# EasyEDA Pro project Foc驱动板.eprj, board PCB6
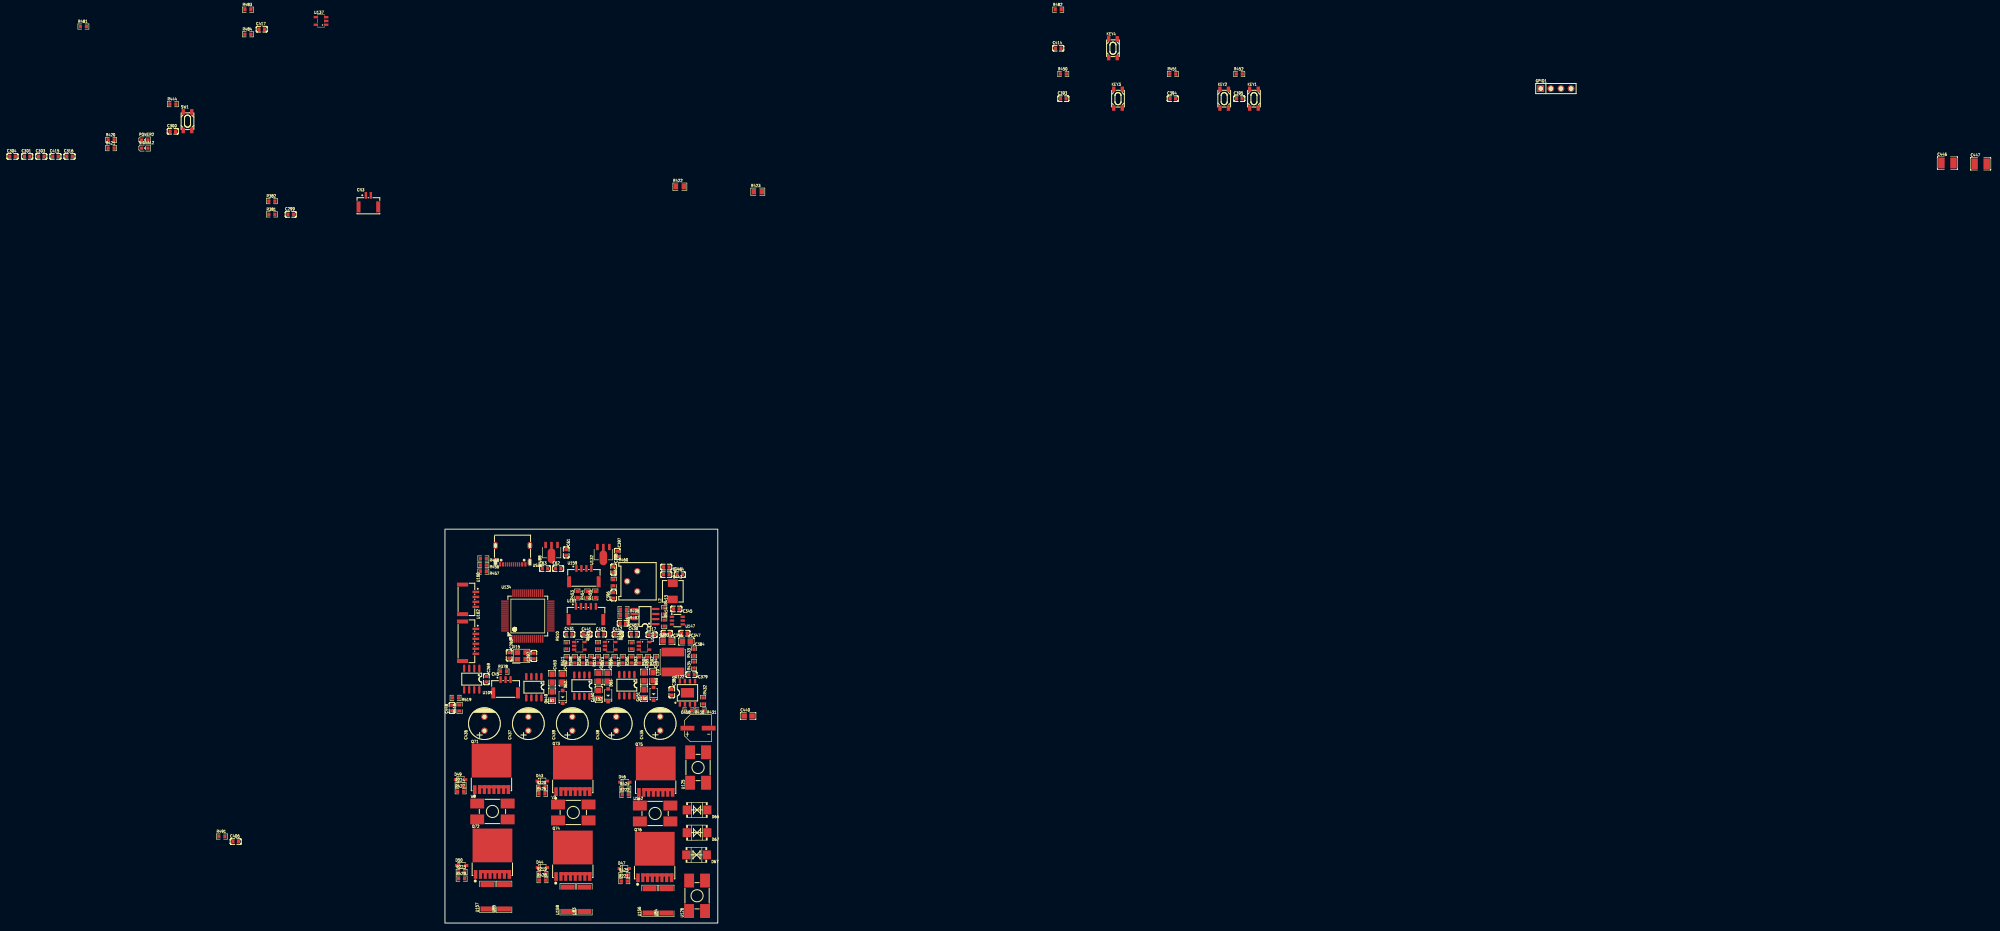
[diagram p14: board, top side]
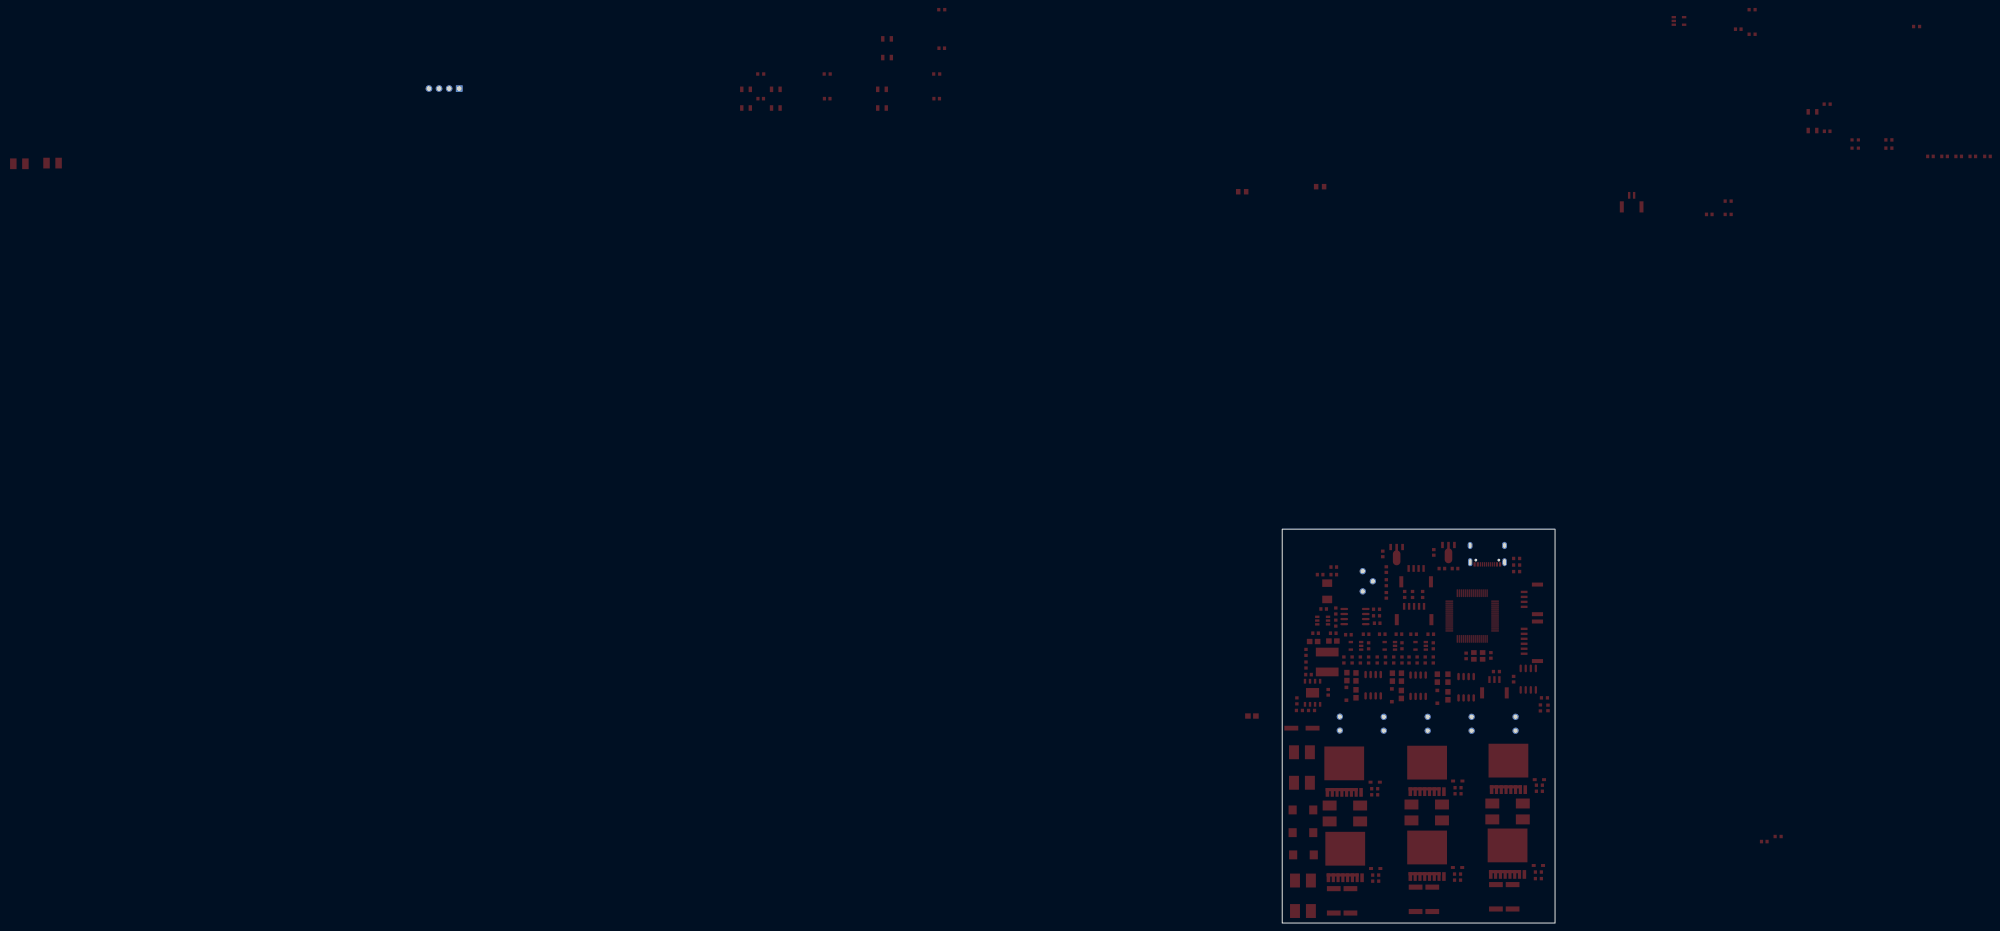
[diagram p15: board, bottom side, seen from below]

Outline 68.58 x 99.06 mm; copper layers: Top Layer, Bottom Layer. Coordinates in mm from the lower left corner of the outline.
Outline path: rectangle 0,99.06 68.58,0
Stack: Top Layer 0.035mm / Dielectric1 1.51mm FR4 er 4.5 / Bottom Layer 0.035mm

## Design rules (mm)
template: JLCPCB Capability(Two Layers Board)
spacing copperThickness1oz (default): track to track 0.102, other pairs 0.152 to 0.3
spacing copperThickness2oz: track to track 0.203, other pairs 0.152 to 0.3
track width copperThickness1oz (default): min 0.127, default 0.254, max 2.54
track width copperThickness2oz: min 0.203, default 0.254, max 2.54
differential pair differentialPair (default): width min 0.127, default 0.254, max 2.54; gap min 0.152, default 0.152
via viaSize (default): diameter min 0.5, default 0.61, max 10; hole min 0.3, default 0.305, max 6.3

## Placement (name value [footprint] x y rotation side)
C61  100nF  [C0603]  30.48 93.22 270 top
C62  10uF  [C0603]  28.45 89.15 0 top
C63  100nF  [C0603]  25.15 89.15 0 top
C269  100nF  [C0603]  10.41 61.34 270 top
C296  22pf  [C0603]  16.13 67.31 270 top
C297  22pf  [C0603]  22.35 67.18 90 top
C299  100nF  [C0603]  -38.77 178.23 0 top
C300  100nF  [C0603]  -68.41 199.13 0 top
C301  100nF  [C0603]  -105.02 192.82 0 top
C303  100nF  [C0603]  -101.47 192.82 0 top
C304  100nF  [C0603]  -108.7 192.82 0 top
C316  100nF  [C0603]  -94.37 192.82 0 top
C317  100nF  [C0603]  51.94 72.52 180 top
C345  100nF  [C0603]  58.17 78.99 180 top
C346  100nF  [C0603]  55.75 72.9 180 top
C347  22uF  [C0603]  60.2 72.9 180 top
C379  1uF  [C0603]  61.98 62.48 180 top
C380  100nF  [C0603]  57.02 58.04 270 top
C383  22uF  [C0805]  55.85 70.93 0 top
C384  22uF  [C0805]  60.69 70.81 180 top
C393  100nF  [C0603]  155.44 207.34 0 top
C394  100nF  [C0603]  182.97 207.34 0 top
C395  100nF  [C0603]  199.68 207.34 0 top
C396  1nF  [C0603]  42.42 82.42 90 top
C397  100nF  [C0603]  43.31 92.84 270 top
C398  10uF  [C0603]  42.42 88.9 270 top
C406  100nF  [C0603]  -52.6 20.49 0 top
C407  100nF  [C0603]  44.72 75.41 180 top
C414  100nF  [C0603]  154.17 220.03 0 top
C415  100nF  [C0603]  -97.92 192.82 0 top
C417  10nF  [C0603]  -46.06 224.81 0 top
C430  1nF  [C0603]  47.5 72.64 180 top
C431  1nF  [C0603]  31.24 72.64 180 top
C432  1nF  [C0603]  39.24 72.66 180 top
C435  100uF  [CAP-TH_BD8.0-P3.50-D0.5-FD]  54.1 50.16 90 top
C436  100uF  [CAP-TH_BD8.0-P3.50-D0.5-FD]  9.92 50.12 90 top
C437  100uF  [CAP-TH_BD8.0-P3.50-D0.5-FD]  20.97 50.12 90 top
C438  100uF  [CAP-TH_BD8.0-P3.50-D0.5-FD]  43.06 50.12 90 top
C439  100uF  [CAP-TH_BD8.0-P3.50-D0.5-FD]  32.01 50.12 90 top
C440  4.7uF  [C0805]  76.2 52.07 0 top
C441  100nF  [C0603]  35.56 72.64 180 top
C442  100nF  [C0603]  43.43 72.66 180 top
C443  22uF  [C0603]  55.63 87.63 180 top
C444  22uF  [C0603]  59.05 87.63 0 top
C445  100nF  [C0603]  55.63 89.53 180 top
C446  100uF  [C1210]  377.7 191.13 0 top
C447  100uF  [C1210]  386.04 190.96 0 top
C448  100nF  [C0603]  1.78 54.1 90 top
C449  4.7uF  [C0805]  26.92 57.15 90 top
C450  4.7uF  [C0805]  38.63 57.49 90 top
C451  4.7uF  [C0805]  50.04 57.66 90 top
C452  1uF  [C0805]  29.59 61.59 270 top
C453  100nF  [C0805]  26.92 61.59 270 top
C454  1uF  [C0805]  52.32 61.98 270 top
C455  100nF  [C0805]  50.05 61.91 270 top
C456  1uF  [C0805]  40.89 61.84 270 top
C457  100nF  [C0805]  38.61 61.85 270 top
C458  22uF  [CAP-SMD_BD6.3-L6.6-W6.6-LS7.4-FD]  63.63 49.02 0 top
CN3  -  [CONN-TH_2P-P1.25_XUNPU_WAFER-GH1.25-2PWB]  -19.26 181.57 0 top
CN5  WAFER-GH1.25-3PLB  [CONN-SMD_3P-P1.25_XUNPU_WAFER-GH1.25-3PLB]  15.24 59.56 0 top
D43  BAT43WS-7-F  [SOD-323_L1.8-W1.3-LS2.5-RD]  24.46 35.72 0 top
D44  BAT43WS-7-F  [SOD-323_L1.8-W1.3-LS2.5-RD]  24.51 13.97 0 top
D46  BAT43WS-7-F  [SOD-323_L1.8-W1.3-LS2.5-RD]  45.21 35.43 0 top
D47  BAT43WS-7-F  [SOD-323_L1.8-W1.3-LS2.5-RD]  45.08 13.72 0 top
D49  BAT43WS-7-F  [SOD-323_L1.8-W1.3-LS2.5-RD]  3.94 36.07 0 top
D50  BAT43WS-7-F  [SOD-323_L1.8-W1.3-LS2.5-RD]  4.19 14.48 0 top
D51  1N4148W  [SOD-123_L2.7-W1.6-LS3.7-FD]  41.02 57.28 270 top
D52  1N4148W  [SOD-123_L2.7-W1.6-LS3.7-FD]  29.59 56.9 270 top
D53  1N4148W  [SOD-123_L2.7-W1.6-LS3.7-FD]  52.45 57.66 270 top
D66  SMBJ48CA  [SMB_L4.6-W3.6-LS5.4-BI]  63.37 28.45 180 top
D67  SMBJ48CA  [SMB_L4.6-W3.6-LS5.4-BI]  63.25 17.15 180 top
D67#2  -  [SMB_L4.6-W3.6-LS5.4-BI]  63.37 22.73 180 top
GPIO1  PZ254V-11-04P  [HDR-TH_4P-P2.54-V-M]  279.27 209.88 0 top
KEY1  TS-1145A-B-A  [SW-SMD_4P-L4.2-W3.2-P2.15-LS5.2]  203.37 207.34 0 top
KEY2  TS-1145A-B-A  [SW-SMD_4P-L4.2-W3.2-P2.15-LS5.2]  195.89 207.34 0 top
KEY3  TS-1145A-B-A  [SW-SMD_4P-L4.2-W3.2-P2.15-LS5.2]  169.19 207.34 0 top
KEY4  TS-1145A-B-A  [SW-SMD_4P-L4.2-W3.2-P2.15-LS5.2]  167.92 220.03 0 top
L2  10uH  [IND-SMD_L5.4-W5.2_FXL0530]  57.28 83.44 90 top
L10  18uH  [IND-SMD_L6.0-W6.0]  57.28 65.66 90 top
POWER2  LTST-C190KSKT  [LED0603-RD]  -75.45 196.96 0 top
Q71  AGM4005LL  [TOLL-8_L10.4-W9.9-P1.20-LS11.7-BL]  11.72 37.2 0 top
Q72  AGM4005LL  [TOLL-8_L10.4-W9.9-P1.20-LS11.7-BL]  11.94 15.88 0 top
Q73  AGM4005LL  [TOLL-8_L10.4-W9.9-P1.20-LS11.7-BL]  32.16 36.69 0 top
Q74  AGM4005LL  [TOLL-8_L10.4-W9.9-P1.20-LS11.7-BL]  32.16 15.35 0 top
Q75  AGM4005LL  [TOLL-8_L10.4-W9.9-P1.20-LS11.7-BL]  52.99 36.51 0 top
Q76  AGM4005LL  [TOLL-8_L10.4-W9.9-P1.20-LS11.7-BL]  52.74 15.04 0 top
R219  10Ω  [R0603]  24.51 12.32 0 top
R220  10Ω  [R0603]  24.38 34.04 0 top
R221  10Ω  [R0603]  45.08 10.54 0 top
R222  10Ω  [R0603]  45.34 32.26 0 top
R223  10Ω  [R0603]  4.19 12.83 0 top
R224  10Ω  [R0603]  3.94 34.67 0 top
R378  120Ω  [R0603]  14.73 63.25 0 top
R381  KNTC0603/10KF3950  [R0603]  -43.52 178.23 0 top
R382  10kΩ  [R0603]  -43.52 181.57 0 top
R413  56KΩ  [R0603]  55.12 78.49 270 top
R414  7.5KΩ  [R0603]  55.12 75.44 270 top
R420  1kΩ  [R0603]  -83.92 196.96 0 top
R421  1kΩ  [R0603]  -83.92 194.9 0 top
R422  0Ω  [R0805]  59.06 185.2 0 top
R423  0Ω  [R0805]  78.64 183.94 0 top
R424  10kΩ  [R0603]  45.34 33.78 0 top
R425  10kΩ  [R0603]  45.08 12.06 0 top
R426  10kΩ  [R0603]  24.38 32.51 0 top
R427  10kΩ  [R0603]  3.94 33.15 0 top
R428  10kΩ  [R0603]  24.51 10.79 0 top
R429  10kΩ  [R0603]  4.19 11.18 0 top
R430  10KΩ  [R0603]  61.21 53.47 180 top
R431  1kΩ  [R0603]  64.26 53.47 180 top
R432  64.9KΩ  [R0603]  64.9 55.88 270 top
R433  100kΩ  [R0603]  62.61 68.07 90 top
R434  9.09kΩ  [R0603]  62.61 64.9 90 top
R444  10KΩ  [R0603]  -68.41 205.96 0 top
R450  10KΩ  [R0603]  155.44 213.54 0 top
R451  10KΩ  [R0603]  182.97 213.54 0 top
R452  10KΩ  [R0603]  199.68 213.54 0 top
R453  1kΩ  [R0603]  33.28 82.64 90 top
R454  1kΩ  [R0603]  35.82 82.64 90 top
R455  1kΩ  [R0603]  37.8 82.64 90 top
R456  1.5kΩ  [R0603]  9.65 90.04 180 top
R457  5.1kΩ  [R0603]  9.65 88.39 180 top
R458  5.1kΩ  [R0603]  9.65 91.69 180 top
R460  10kΩ  [RES-ADJ-TH_3P-L9.5-W9.5-P2.54-BR-BS]  47.08 85.96 0 top
R461  10kΩ  [R0603]  42.42 85.6 270 top
R481  10KΩ  [R0603]  -90.89 225.48 0 top
R482  10KΩ  [R0603]  154.17 229.72 0 top
R483  10kΩ  [R0603]  -49.54 229.72 0 top
R484  10kΩ  [R0603]  -49.54 223.54 0 top
R491  10kΩ  [R0603]  -56.08 21.76 0 top
R496  1kΩ  [R0603]  44.87 78.92 180 top
R497  1kΩ  [R0603]  44.87 77.27 180 top
R502  20kΩ  [R0603]  53.09 66.17 90 top
R503  1kΩ  [R0603]  48.94 66.17 270 top
R504  1kΩ  [R0603]  51.01 66.17 270 top
R505  22Ω  [R0603]  46.86 69.72 270 top
R506  20kΩ  [R0603]  46.86 66.17 90 top
R507  20kΩ  [R0603]  36.7 66.17 90 top
R508  1kΩ  [R0603]  32.64 66.17 270 top
R509  1kΩ  [R0603]  34.67 66.17 270 top
R510  22Ω  [R0603]  30.61 69.72 270 top
R511  20kΩ  [R0603]  30.61 66.17 90 top
R512  20kΩ  [R0603]  44.7 66.17 90 top
R513  1kΩ  [R0603]  40.56 66.17 270 top
R514  1kΩ  [R0603]  42.63 66.17 270 top
R515  22Ω  [R0603]  38.48 69.73 270 top
R516  20kΩ  [R0603]  38.48 66.17 90 top
R518  10kΩ  [R0603]  3.68 54.1 90 top
R519  1kΩ  [R0603]  2.67 56.64 180 top
SIGNAL2  LTST-C190KSKT  [LED0603-RD]  -75.45 194.9 0 top
SW1  TS-1145A-B-A  [SW-SMD_4P-L4.2-W3.2-P2.15-LS5.2]  -64.72 201.67 0 top
U83  5mΩ  [R2512]  35.05 5.97 90 top
U84  5mΩ  [R2512]  55.63 5.59 90 top
U85  5mΩ  [R2512]  14.86 6.6 90 top
U88  AMS1117-3.3  [SOT-89_L4.5-W2.5-P1.50-LS4.2-BR]  26.8 93.73 90 top
U109  TJA1050T/CM,118  [SOIC-8_L5.0-W4.0-P1.27-LS6.0-BL]  6.73 61.34 180 top
U122  LGS54360  [ESOP-8_L4.9-W3.9-P1.27-LS6.0-BL-EP]  60.96 57.91 0 top
U125  TS34031  [CONN-SMD_TS34031]  63.63 39.12 90 top
U126  TS34031  [CONN-SMD_TS34031]  63.37 6.86 90 top
U132  AMS1117-3.3  [SOT-89_L4.5-W2.5-P1.50-LS4.2-BR]  39.83 93.22 90 top
U134  STM32G431RBT6  [LQFP-64_L10.0-W10.0-P0.50-LS12.0-BL]  20.83 77.22 0 top
U135  M24C64-RMN6TP  [SOIC-8_L5.0-W4.0-P1.27-LS6.0-BL]  50.29 77.09 90 top
U137  LM321MFX/NOPB  [SOT-23-5_L3.0-W1.7-P0.95-LS2.8-BR]  -31.15 226.88 0 top
U142  TS34031  [CONN-SMD_TS34031]  52.83 27.56 0 top
U147  LGS5116B  [SOT-23-6_L2.9-W1.6-P0.95-LS2.8-BR]  58.42 76.07 180 top
U150  EG2132  [SOP-8_L4.9-W3.9-P1.27-LS6.0-BL]  45.72 59.82 180 top
U151  EG2132  [SOP-8_L4.9-W3.9-P1.27-LS6.0-BL]  22.35 59.31 180 top
U152  EG2132  [SOP-8_L4.9-W3.9-P1.27-LS6.0-BL]  34.42 59.69 180 top
U153  RS821XF  [SOT-23-5_L3.0-W1.7-P0.95-LS2.8-BR]  41.53 69.72 180 top
U154  RS821XF  [SOT-23-5_L3.0-W1.7-P0.95-LS2.8-BR]  33.78 69.72 180 top
U155  RS821XF  [SOT-23-5_L3.0-W1.7-P0.95-LS2.8-BR]  50.04 69.72 180 top
U156  5mΩ  [R2512]  51.43 5.59 90 top
U157  5mΩ  [R2512]  10.67 6.6 90 top
U158  5mΩ  [R2512]  30.86 5.97 90 top
U159  WAFER-GH1.25-4PLB  [CONN-SMD_4P-P1.25_XUNPU_WAFER-GH1.25-4PLB]  34.92 87.5 0 top
U160  WAFER-GH1.25-4PLB  [CONN-SMD_4P-P1.25_XUNPU_WAFER-GH1.25-4PLB]  6.1 81.41 270 top
U161  WAFER-GH1.25-5PLB  [CONN-SMD_5P-P1.25_XUNPU_WAFER-GH1.25-5PLB]  35.43 77.98 0 top
U162  WAFER-GH1.25-6PLB  [CONN-SMD_6P-P1.25_XUNPU_WAFER-GH1.25-6PLB]  6.1 70.87 270 top
USB1  TYPE-C 16PIN 2MD(073)  [USB-C-SMD_TYPE-C-6PIN-2MD-073]  17.02 92.58 180 top
V2  TS34031  [CONN-SMD_TS34031]  32.26 27.81 0 top
W2  TS34031  [CONN-SMD_TS34031]  11.94 28.07 0 top
X15  8MHz  [CRYSTAL-SMD_4P-L3.2-W2.5-BL]  19.3 67.18 0 top

## Footprints (pads in the part's own frame, mm; a bottom-side part is the same pattern mirrored in y, then rotated)
C0603
  rect 0.8x0.9 smd: 1(-0.7,0) 2(0.7,0)
C0805
  rect 1.41x1.35 smd: 1(-1,0) 2(1,0)
C1210
  rect 1.635x2.7 smd: 1(-1.518,0) 2(1.518,0)
CAP-SMD_BD6.3-L6.6-W6.6-LS7.4-FD
  rect 3.5x1.2 smd: 1(-2.67,0) 2(2.67,0)
CAP-TH_BD8.0-P3.50-D0.5-FD
  round 1.6 hole 1: 1(-1.75,0) 2(1.75,0)
CONN-SMD_3P-P1.25_XUNPU_WAFER-GH1.25-3PLB
  rect 0.6x1.7 smd: 1(-1.25,1.675) 2(0.001,1.675) 3(1.25,1.675)
  rect 1x2.8 smd: 4(3.1,-1.675) 5(-3.1,-1.675)
CONN-SMD_4P-P1.25_XUNPU_WAFER-GH1.25-4PLB
  rect 0.6x1.7 smd: 1(-1.875,1.675) 2(-0.625,1.675) 3(0.625,1.675) 4(1.875,1.675)
  rect 1x2.8 smd: 5(-3.725,-1.675) 6(3.725,-1.675)
CONN-SMD_5P-P1.25_XUNPU_WAFER-GH1.25-5PLB
  rect 0.6x1.7 smd: 1(-2.5,1.675) 2(-1.25,1.675) 3(0.001,1.675) 4(1.25,1.675) 5(2.5,1.675)
  rect 1x2.8 smd: 6(4.35,-1.675) 7(-4.35,-1.675)
CONN-SMD_6P-P1.25_XUNPU_WAFER-GH1.25-6PLB
  rect 0.6x1.7 smd: 1(-3.125,1.675) 2(-1.875,1.675) 3(-0.625,1.675) 4(0.625,1.675) 5(1.875,1.675) 6(3.125,1.675)
  rect 1x2.8 smd: 7(4.975,-1.675) 8(-4.975,-1.675)
CONN-SMD_TS34031
  rect 3.5x2.5 smd: 1(-3.835,2) 2(-3.835,-2) 3(3.835,-2) 4(3.835,2)
CONN-TH_2P-P1.25_XUNPU_WAFER-GH1.25-2PWB
  rect 0.6x1.7 smd: 1(-0.625,1.45) 2(0.625,1.45)
  rect 1x2.8 smd: 3(-2.475,-1.45) 4(2.475,-1.45)
CRYSTAL-SMD_4P-L3.2-W2.5-BL
  rect 1.4x1.2 smd: 1(-1.1,-0.85) 2(1.1,-0.85) 3(1.1,0.85) 4(-1.1,0.85)
ESOP-8_L4.9-W3.9-P1.27-LS6.0-BL-EP
  rect 0.6x1.2 smd: 1(-1.905,-2.909) 2(-0.635,-2.909) 3(0.635,-2.909) 4(1.905,-2.909) 5(1.905,2.909) 6(0.635,2.909) 7(-0.635,2.909) 8(-1.905,2.909)
  rect 3.3x2.4 smd: 9(0,0)
HDR-TH_4P-P2.54-V-M
  rect 1.7x1.7 hole 1.1: 1(-3.81,0)
  round 1.7 hole 1.1: 2(-1.27,0) 3(1.27,0) 4(3.81,0)
IND-SMD_L5.4-W5.2_FXL0530
  rect 1.9x2.5 smd: 1(-2.05,0) 2(2.05,0)
IND-SMD_L6.0-W6.0
  rect 2.2x5.72 smd: 1(-2.5,0) 2(2.5,0)
LED0603-RD
  rect 0.8x0.8 smd: 1(-0.799,0) 2(0.799,0)
LQFP-64_L10.0-W10.0-P0.50-LS12.0-BL
  oval 0.3x2 smd: 1(-3.75,-5.75) 2(-3.25,-5.75) 3(-2.75,-5.75) 4(-2.25,-5.75) 5(-1.75,-5.75) 6(-1.25,-5.75) 7(-0.75,-5.75) 8(-0.25,-5.75) 9(0.25,-5.75) 10(0.75,-5.75) 11(1.25,-5.75) 12(1.75,-5.75) 13(2.25,-5.75) 14(2.75,-5.75) 15(3.25,-5.75) 16(3.75,-5.75) 33(3.75,5.75) 34(3.25,5.75) 35(2.75,5.75) 36(2.25,5.75) 37(1.75,5.75) 38(1.25,5.75) 39(0.75,5.75) 40(0.25,5.75) 41(-0.25,5.75) 42(-0.75,5.75) 43(-1.25,5.75) 44(-1.75,5.75) 45(-2.25,5.75) 46(-2.75,5.75) 47(-3.25,5.75) 48(-3.75,5.75)
  oval 2x0.3 smd: 17(5.75,-3.75) 18(5.75,-3.25) 19(5.75,-2.75) 20(5.75,-2.25) 21(5.75,-1.75) 22(5.75,-1.25) 23(5.75,-0.75) 24(5.75,-0.25) 25(5.75,0.25) 26(5.75,0.75) 27(5.75,1.25) 28(5.75,1.75) 29(5.75,2.25) 30(5.75,2.75) 31(5.75,3.25) 32(5.75,3.75) 49(-5.75,3.75) 50(-5.75,3.25) 51(-5.75,2.75) 52(-5.75,2.25) 53(-5.75,1.75) 54(-5.75,1.25) 55(-5.75,0.75) 56(-5.75,0.25) 57(-5.75,-0.25) 58(-5.75,-0.75) 59(-5.75,-1.25) 60(-5.75,-1.75) 61(-5.75,-2.25) 62(-5.75,-2.75) 63(-5.75,-3.25) 64(-5.75,-3.75)
R0603
  rect 0.806x0.864 smd: 1(-0.753,0) 2(0.753,0)
R0805
  rect 1.133x1.377 smd: 1(-1,0) 2(1,0)
R2512
  rect 1.282x3.456 smd: 1(-3.067,0) 2(3.067,0)
RES-ADJ-TH_3P-L9.5-W9.5-P2.54-BR-BS
  round 1.6 hole 1: 1(1.27,-2.54) 2(-1.27,0) 3(1.27,2.54)
SMB_L4.6-W3.6-LS5.4-BI
  rect 2.047x2.241 smd: 1(-2.591,0) 2(2.591,0)
SOD-123_L2.7-W1.6-LS3.7-FD
  rect 0.88x0.96 smd: 1(-1.61,0) 2(1.61,0)
SOD-323_L1.8-W1.3-LS2.5-RD
  rect 1x0.75 smd: 1(-1.173,0) 2(1.173,0)
SOIC-8_L5.0-W4.0-P1.27-LS6.0-BL
  oval 0.569x1.95 smd: 1(-1.905,-2.705) 2(-0.635,-2.705) 3(0.635,-2.705) 4(1.905,-2.705) 5(1.905,2.705) 6(0.635,2.705) 7(-0.635,2.705) 8(-1.905,2.705)
SOP-8_L4.9-W3.9-P1.27-LS6.0-BL
  oval 0.63x1.865 smd: 1(-1.905,-2.683) 2(-0.635,-2.683) 3(0.635,-2.683) 4(1.905,-2.683) 5(1.905,2.683) 6(0.635,2.683) 7(-0.635,2.683) 8(-1.905,2.683)
SOT-23-5_L3.0-W1.7-P0.95-LS2.8-BR
  rect 1.1x0.6 smd: 1(1.3,-0.95) 2(1.3,0) 3(1.3,0.95) 4(-1.3,0.95) 5(-1.3,-0.95)
SOT-23-6_L2.9-W1.6-P0.95-LS2.8-BR
  rect 1.1x0.6 smd: 1(1.35,-0.95) 2(1.35,0) 3(1.35,0.95) 4(-1.35,0.95) 5(-1.35,0) 6(-1.35,-0.95)
SOT-89_L4.5-W2.5-P1.50-LS4.2-BR
  rect 1.575x0.672 smd: 1(1.356,-1.5) 3(1.356,1.5)
  custom 0x0 smd: 2(-1.356,0.009)
SW-SMD_4P-L4.2-W3.2-P2.15-LS5.2
  rect 0.85x1.4 smd: 1(1.075,2.35) 2(1.075,-2.35) 3(-1.075,2.35) 4(-1.075,-2.35)
TOLL-8_L10.4-W9.9-P1.20-LS11.7-BL
  rect 0.9x2.2 smd: 1(-4.225,-3.65) 8(4.225,-3.65)
  rect 0.8x2.2 smd: 2(-3,-3.65) 3(-1.8,-3.65) 4(-0.6,-3.65) 5(0.6,-3.65) 6(1.8,-3.65) 7(3,-3.65)
  rect 8.08x0.8 smd: 8(0.64,-2.95)
  rect 10x8.5 smd: 9(0,3.65)
USB-C-SMD_TYPE-C-6PIN-2MD-073
  rect 0.55x1.1 smd: 1(-3.2,2.375) 2(-2.4,2.375) 11(2.4,2.375) 12(3.2,2.375)
  rect 0.3x1.1 smd: 3(-1.75,2.375) 4(-1.25,2.375) 5(-0.75,2.375) 6(-0.25,2.375) 7(0.25,2.375) 8(0.75,2.375) 9(1.25,2.375) 10(1.75,2.375)
  oval 1.1x2 hole 0.6x1.5: 13(-4.325,1.825) 14(4.325,1.825)
  oval 1.2x1.8 hole 0.6x1.2: 13(-4.325,-2.375) 14(4.325,-2.375)

## Nets
As in the schematic, except:
3.3V: C62.1 C63.1 C301.2 C303.2 C304.2 C407.2 C415.2 CN3.2 POWER2.2 R382.1 R444.2 R450.2 R451.2 R452.2 R456.1 R460.3 R482.2 R496.2 R497.2 SIGNAL2.2 U88.2 U134.1 U134.16 U134.29 U134.32 U134.48 U134.64 U135.8 U159.1 U160.1 U161.5 U162.1
GND: C61.2 C62.2 C63.2 C269.2 C296.1 C297.1 C299.1 C300.1 C301.1 C303.1 C304.1 C346.2 C347.1 C379.1 C383.1 C384.1 C393.1 C394.1 C395.1 C396.1 C406.1 C407.1 C414.1 C415.1 C440.1 C443.2 C444.2 C445.2 C448.1 C452.1 C453.1 C454.1 C455.1 C456.1 C457.1 C458.2 CN3.3 CN3.4 CN5.3 CN5.4 CN5.5 GPIO1.4 KEY1.3 KEY2.3 KEY3.3 KEY4.3 R381.1 R414.2 R420.2 R422.1 R423.2 R431.1 R432.1 R434.1 R457.2 R458.2 R460.1 R481.1 R491.2 R519.2 SW1.3 U88.1 U109.2 U109.8 U122.7 U122.9 U134.15 U134.31 U134.47 U134.63 U135.1 U135.2 U135.3 U135.4 U135.7 U147.2 U150.4 U151.4 U152.4 U159.4 U159.5 U159.6 U160.4 U160.5 U160.6 U161.1 U161.6 U161.7 U162.6 U162.7 U162.8 USB1.1 USB1.12 USB1.13 USB1.14 X15.2 X15.4
PGND: C435.2 C436.2 C437.2 C438.2 C439.2 C446.1 C447.1 D66.1 D67.1 D67#2.1 R422.2 R425.1 R428.1 R429.1 R503.2 R508.2 R513.2 U83.1 U84.1 U85.1 U126.1 U126.2 U126.3 U126.4 U156.1 U157.1 U158.1
VBUS: C435.1 C436.1 C437.1 C438.1 C439.1 C440.2 C446.2 C447.2 C458.1 D66.2 D67.2 D67#2.2 Q71.9 Q73.9 Q75.9 R430.2 R518.1 U122.2 U125.1 U125.2 U125.3 U125.4
NTC2: C406.2 CN3.1 R491.1 U134.36

Pads without a net: KEY1 1 4; KEY2 1 4; KEY3 1 4; KEY4 1 4; SW1 1 4; U109 5; U134 3 4; USB1 3 9
